# EAGLE schematic Resistor_Resistor (EAGLE 8.3.0), part 31 of 43 (continued)
## Nets (continued)
N$46: R7601.2 R7602.2 R7603.2 R7604.2 R7605.2 R7606.2 R7607.2 R7608.2 R7609.2 R7610.2 R7611.2 R7612.2 R7613.2 R7614.2 R7615.2 R7616.2 R7617.2 R7618.2 R7619.2 R7620.2 R7621.2 R7622.2 R7623.2 R7624.2 R7625.2 R7626.2 R7627.2 R7628.2 R7629.2 R7630.2 R7631.2 R7632.2 R7633.2 R7634.2 R7635.2 R7636.2 R7637.2 R7638.2 R7639.2 R7640.2 R7641.2 R7642.2 R7643.2 R7644.2 R7645.2 R7646.2 R7647.2 R7648.2 R7649.2 R7650.2 R7651.2 R7652.2 R7653.2 R7654.2 R7655.2 R7656.2 R7657.2 R7658.2 R7659.2 R7660.2 R7661.2 R7662.2 R7663.2 R7664.2 R7665.2 R7666.2 R7667.2 R7668.2 R7669.2 R7670.2 R7671.2 R7672.2 R7673.2 R7674.2 R7675.2 R7676.2 R7677.2 R7678.2 R7679.2 R7680.2 R7681.2 R7682.2 R7683.2 R7684.2 R7685.2 R7686.2 R7687.2 R7688.2 R7689.2 R7690.2 R7691.2 R7692.2 R7693.2 R7694.2 R7695.2 R7696.2 R7697.2 R7698.2 R7699.2 R7700.2 R7701.2 R7702.2 R7703.2 R7704.2 R7705.2 R7706.2 R7707.2 R7708.2 R7709.2 R7710.2 R7711.2 R7712.2 R7713.2 R7714.2 R7715.2 R7716.2 R7717.2 R7718.2 R7719.2 R7720.2 R7721.2 R7722.2 R7723.2 R7724.2 R7725.2 R7726.2 R7727.2 R7728.2 R7729.2 R7730.2 R7731.2 R7732.2 R7733.2 R7734.2 R7735.2 R7736.2 R7737.2 R7738.2 R7739.2 R7740.2 R7741.2 R7742.2 R7743.2 R7744.2 R7745.2 R7746.2 R7747.2 R7748.2 R7749.2 R7750.2 R7751.2 R7752.2 R7753.2 R7754.2 R7755.2 R7756.2 R7757.2 R7758.2 R7759.2 R7760.2 R7761.2 R7762.2 R7763.2 R7764.2 R7765.2 R7766.2 R7767.2 R7768.2 R7769.2 R7770.2 R7771.2 R7772.2 R7773.2 R7774.2 R7775.2 R7776.2 R7777.2 R7778.2 R7779.2 R7780.2 R7781.2 R7782.2 R7783.2 R7784.2 R7785.2 R7786.2 R7787.2 R7788.2 R7789.2 R7790.2 R7791.2 R7792.2 R7793.2 R7794.2 R7795.2 R7796.2 R7797.2 R7798.2 R7799.2 R7800.2 R7801.1 R7802.1 R7803.1 R7804.1 R7805.1 R7806.1 R7807.1 R7808.1 R7809.1 R7810.1 R7811.1 R7812.1 R7813.1 R7814.1 R7815.1 R7816.1 R7817.1 R7818.1 R7819.1 R7820.1 R7821.1 R7822.1 R7823.1 R7824.1 R7825.1 R7826.1 R7827.1 R7828.1 R7829.1 R7830.1 R7831.1 R7832.1 R7833.1 R7834.1 R7835.1 R7836.1 R7837.1 R7838.1 R7839.1 R7840.1 R7841.1 R7842.1 R7843.1 R7844.1 R7845.1 R7846.1 R7847.1 R7848.1 R7849.1 R7850.1 R7851.1 R7852.1 R7853.1 R7854.1 R7855.1 R7856.1 R7857.1 R7858.1 R7859.1 R7860.1 R7861.1 R7862.1 R7863.1 R7864.1 R7865.1 R7866.1 R7867.1 R7868.1 R7869.1 R7870.1 R7871.1 R7872.1 R7873.1 R7874.1 R7875.1 R7876.1 R7877.1 R7878.1 R7879.1 R7880.1 R7881.1 R7882.1 R7883.1 R7884.1 R7885.1 R7886.1 R7887.1 R7888.1 R7889.1 R7890.1 R7891.1 R7892.1 R7893.1 R7894.1 R7895.1 R7896.1 R7897.1 R7898.1 R7899.1 R7900.1 R7901.1 R7902.1 R7903.1 R7904.1 R7905.1 R7906.1 R7907.1 R7908.1 R7909.1 R7910.1 R7911.1 R7912.1 R7913.1 R7914.1 R7915.1 R7916.1 R7917.1 R7918.1 R7919.1 R7920.1 R7921.1 R7922.1 R7923.1 R7924.1 R7925.1 R7926.1 R7927.1 R7928.1 R7929.1 R7930.1 R7931.1 R7932.1 R7933.1 R7934.1 R7935.1 R7936.1 R7937.1 R7938.1 R7939.1 R7940.1 R7941.1 R7942.1 R7943.1 R7944.1 R7945.1 R7946.1 R7947.1 R7948.1 R7949.1 R7950.1 R7951.1 R7952.1 R7953.1 R7954.1 R7955.1 R7956.1 R7957.1 R7958.1 R7959.1 R7960.1 R7961.1 R7962.1 R7963.1 R7964.1 R7965.1 R7966.1 R7967.1 R7968.1 R7969.1 R7970.1 R7971.1 R7972.1 R7973.1 R7974.1 R7975.1 R7976.1 R7977.1 R7978.1 R7979.1 R7980.1 R7981.1 R7982.1 R7983.1 R7984.1 R7985.1 R7986.1 R7987.1 R7988.1 R7989.1 R7990.1 R7991.1 R7992.1 R7993.1 R7994.1 R7995.1 R7996.1 R7997.1 R7998.1 R7999.1 R8000.1
N$47: R7801.2 R7802.2 R7803.2 R7804.2 R7805.2 R7806.2 R7807.2 R7808.2 R7809.2 R7810.2 R7811.2 R7812.2 R7813.2 R7814.2 R7815.2 R7816.2 R7817.2 R7818.2 R7819.2 R7820.2 R7821.2 R7822.2 R7823.2 R7824.2 R7825.2 R7826.2 R7827.2 R7828.2 R7829.2 R7830.2 R7831.2 R7832.2 R7833.2 R7834.2 R7835.2 R7836.2 R7837.2 R7838.2 R7839.2 R7840.2 R7841.2 R7842.2 R7843.2 R7844.2 R7845.2 R7846.2 R7847.2 R7848.2 R7849.2 R7850.2 R7851.2 R7852.2 R7853.2 R7854.2 R7855.2 R7856.2 R7857.2 R7858.2 R7859.2 R7860.2 R7861.2 R7862.2 R7863.2 R7864.2 R7865.2 R7866.2 R7867.2 R7868.2 R7869.2 R7870.2 R7871.2 R7872.2 R7873.2 R7874.2 R7875.2 R7876.2 R7877.2 R7878.2 R7879.2 R7880.2 R7881.2 R7882.2 R7883.2 R7884.2 R7885.2 R7886.2 R7887.2 R7888.2 R7889.2 R7890.2 R7891.2 R7892.2 R7893.2 R7894.2 R7895.2 R7896.2 R7897.2 R7898.2 R7899.2 R7900.2 R7901.2 R7902.2 R7903.2 R7904.2 R7905.2 R7906.2 R7907.2 R7908.2 R7909.2 R7910.2 R7911.2 R7912.2 R7913.2 R7914.2 R7915.2 R7916.2 R7917.2 R7918.2 R7919.2 R7920.2 R7921.2 R7922.2 R7923.2 R7924.2 R7925.2 R7926.2 R7927.2 R7928.2 R7929.2 R7930.2 R7931.2 R7932.2 R7933.2 R7934.2 R7935.2 R7936.2 R7937.2 R7938.2 R7939.2 R7940.2 R7941.2 R7942.2 R7943.2 R7944.2 R7945.2 R7946.2 R7947.2 R7948.2 R7949.2 R7950.2 R7951.2 R7952.2 R7953.2 R7954.2 R7955.2 R7956.2 R7957.2 R7958.2 R7959.2 R7960.2 R7961.2 R7962.2 R7963.2 R7964.2 R7965.2 R7966.2 R7967.2 R7968.2 R7969.2 R7970.2 R7971.2 R7972.2 R7973.2 R7974.2 R7975.2 R7976.2 R7977.2 R7978.2 R7979.2 R7980.2 R7981.2 R7982.2 R7983.2 R7984.2 R7985.2 R7986.2 R7987.2 R7988.2 R7989.2 R7990.2 R7991.2 R7992.2 R7993.2 R7994.2 R7995.2 R7996.2 R7997.2 R7998.2 R7999.2 R8000.2 R8001.1 R8002.1 R8003.1 R8004.1 R8005.1 R8006.1 R8007.1 R8008.1 R8009.1 R8010.1 R8011.1 R8012.1 R8013.1 R8014.1 R8015.1 R8016.1 R8017.1 R8018.1 R8019.1 R8020.1 R8021.1 R8022.1 R8023.1 R8024.1 R8025.1 R8026.1 R8027.1 R8028.1 R8029.1 R8030.1 R8031.1 R8032.1 R8033.1 R8034.1 R8035.1 R8036.1 R8037.1 R8038.1 R8039.1 R8040.1 R8041.1 R8042.1 R8043.1 R8044.1 R8045.1 R8046.1 R8047.1 R8048.1 R8049.1 R8050.1 R8051.1 R8052.1 R8053.1 R8054.1 R8055.1 R8056.1 R8057.1 R8058.1 R8059.1 R8060.1 R8061.1 R8062.1 R8063.1 R8064.1 R8065.1 R8066.1 R8067.1 R8068.1 R8069.1 R8070.1 R8071.1 R8072.1 R8073.1 R8074.1 R8075.1 R8076.1 R8077.1 R8078.1 R8079.1 R8080.1 R8081.1 R8082.1 R8083.1 R8084.1 R8085.1 R8086.1 R8087.1 R8088.1 R8089.1 R8090.1 R8091.1 R8092.1 R8093.1 R8094.1 R8095.1 R8096.1 R8097.1 R8098.1 R8099.1 R8100.1 R8101.1 R8102.1 R8103.1 R8104.1 R8105.1 R8106.1 R8107.1 R8108.1 R8109.1 R8110.1 R8111.1 R8112.1 R8113.1 R8114.1 R8115.1 R8116.1 R8117.1 R8118.1 R8119.1 R8120.1 R8121.1 R8122.1 R8123.1 R8124.1 R8125.1 R8126.1 R8127.1 R8128.1 R8129.1 R8130.1 R8131.1 R8132.1 R8133.1 R8134.1 R8135.1 R8136.1 R8137.1 R8138.1 R8139.1 R8140.1 R8141.1 R8142.1 R8143.1 R8144.1 R8145.1 R8146.1 R8147.1 R8148.1 R8149.1 R8150.1 R8151.1 R8152.1 R8153.1 R8154.1 R8155.1 R8156.1 R8157.1 R8158.1 R8159.1 R8160.1 R8161.1 R8162.1 R8163.1 R8164.1 R8165.1 R8166.1 R8167.1 R8168.1 R8169.1 R8170.1 R8171.1 R8172.1 R8173.1 R8174.1 R8175.1 R8176.1 R8177.1 R8178.1 R8179.1 R8180.1 R8181.1 R8182.1 R8183.1 R8184.1 R8185.1 R8186.1 R8187.1 R8188.1 R8189.1 R8190.1 R8191.1 R8192.1 R8193.1 R8194.1 R8195.1 R8196.1 R8197.1 R8198.1 R8199.1 R8200.1
N$48: R8001.2 R8002.2 R8003.2 R8004.2 R8005.2 R8006.2 R8007.2 R8008.2 R8009.2 R8010.2 R8011.2 R8012.2 R8013.2 R8014.2 R8015.2 R8016.2 R8017.2 R8018.2 R8019.2 R8020.2 R8021.2 R8022.2 R8023.2 R8024.2 R8025.2 R8026.2 R8027.2 R8028.2 R8029.2 R8030.2 R8031.2 R8032.2 R8033.2 R8034.2 R8035.2 R8036.2 R8037.2 R8038.2 R8039.2 R8040.2 R8041.2 R8042.2 R8043.2 R8044.2 R8045.2 R8046.2 R8047.2 R8048.2 R8049.2 R8050.2 R8051.2 R8052.2 R8053.2 R8054.2 R8055.2 R8056.2 R8057.2 R8058.2 R8059.2 R8060.2 R8061.2 R8062.2 R8063.2 R8064.2 R8065.2 R8066.2 R8067.2 R8068.2 R8069.2 R8070.2 R8071.2 R8072.2 R8073.2 R8074.2 R8075.2 R8076.2 R8077.2 R8078.2 R8079.2 R8080.2 R8081.2 R8082.2 R8083.2 R8084.2 R8085.2 R8086.2 R8087.2 R8088.2 R8089.2 R8090.2 R8091.2 R8092.2 R8093.2 R8094.2 R8095.2 R8096.2 R8097.2 R8098.2 R8099.2 R8100.2 R8101.2 R8102.2 R8103.2 R8104.2 R8105.2 R8106.2 R8107.2 R8108.2 R8109.2 R8110.2 R8111.2 R8112.2 R8113.2 R8114.2 R8115.2 R8116.2 R8117.2 R8118.2 R8119.2 R8120.2 R8121.2 R8122.2 R8123.2 R8124.2 R8125.2 R8126.2 R8127.2 R8128.2 R8129.2 R8130.2 R8131.2 R8132.2 R8133.2 R8134.2 R8135.2 R8136.2 R8137.2 R8138.2 R8139.2 R8140.2 R8141.2 R8142.2 R8143.2 R8144.2 R8145.2 R8146.2 R8147.2 R8148.2 R8149.2 R8150.2 R8151.2 R8152.2 R8153.2 R8154.2 R8155.2 R8156.2 R8157.2 R8158.2 R8159.2 R8160.2 R8161.2 R8162.2 R8163.2 R8164.2 R8165.2 R8166.2 R8167.2 R8168.2 R8169.2 R8170.2 R8171.2 R8172.2 R8173.2 R8174.2 R8175.2 R8176.2 R8177.2 R8178.2 R8179.2 R8180.2 R8181.2 R8182.2 R8183.2 R8184.2 R8185.2 R8186.2 R8187.2 R8188.2 R8189.2 R8190.2 R8191.2 R8192.2 R8193.2 R8194.2 R8195.2 R8196.2 R8197.2 R8198.2 R8199.2 R8200.2 R8201.1 R8202.1 R8203.1 R8204.1 R8205.1 R8206.1 R8207.1 R8208.1 R8209.1 R8210.1 R8211.1 R8212.1 R8213.1 R8214.1 R8215.1 R8216.1 R8217.1 R8218.1 R8219.1 R8220.1 R8221.1 R8222.1 R8223.1 R8224.1 R8225.1 R8226.1 R8227.1 R8228.1 R8229.1 R8230.1 R8231.1 R8232.1 R8233.1 R8234.1 R8235.1 R8236.1 R8237.1 R8238.1 R8239.1 R8240.1 R8241.1 R8242.1 R8243.1 R8244.1 R8245.1 R8246.1 R8247.1 R8248.1 R8249.1 R8250.1 R8251.1 R8252.1 R8253.1 R8254.1 R8255.1 R8256.1 R8257.1 R8258.1 R8259.1 R8260.1 R8261.1 R8262.1 R8263.1 R8264.1 R8265.1 R8266.1 R8267.1 R8268.1 R8269.1 R8270.1 R8271.1 R8272.1 R8273.1 R8274.1 R8275.1 R8276.1 R8277.1 R8278.1 R8279.1 R8280.1 R8281.1 R8282.1 R8283.1 R8284.1 R8285.1 R8286.1 R8287.1 R8288.1 R8289.1 R8290.1 R8291.1 R8292.1 R8293.1 R8294.1 R8295.1 R8296.1 R8297.1 R8298.1 R8299.1 R8300.1 R8301.1 R8302.1 R8303.1 R8304.1 R8305.1 R8306.1 R8307.1 R8308.1 R8309.1 R8310.1 R8311.1 R8312.1 R8313.1 R8314.1 R8315.1 R8316.1 R8317.1 R8318.1 R8319.1 R8320.1 R8321.1 R8322.1 R8323.1 R8324.1 R8325.1 R8326.1 R8327.1 R8328.1 R8329.1 R8330.1 R8331.1 R8332.1 R8333.1 R8334.1 R8335.1 R8336.1 R8337.1 R8338.1 R8339.1 R8340.1 R8341.1 R8342.1 R8343.1 R8344.1 R8345.1 R8346.1 R8347.1 R8348.1 R8349.1 R8350.1 R8351.1 R8352.1 R8353.1 R8354.1 R8355.1 R8356.1 R8357.1 R8358.1 R8359.1 R8360.1 R8361.1 R8362.1 R8363.1 R8364.1 R8365.1 R8366.1 R8367.1 R8368.1 R8369.1 R8370.1 R8371.1 R8372.1 R8373.1 R8374.1 R8375.1 R8376.1 R8377.1 R8378.1 R8379.1 R8380.1 R8381.1 R8382.1 R8383.1 R8384.1 R8385.1 R8386.1 R8387.1 R8388.1 R8389.1 R8390.1 R8391.1 R8392.1 R8393.1 R8394.1 R8395.1 R8396.1 R8397.1 R8398.1 R8399.1 R8400.1
N$49: R8201.2 R8202.2 R8203.2 R8204.2 R8205.2 R8206.2 R8207.2 R8208.2 R8209.2 R8210.2 R8211.2 R8212.2 R8213.2 R8214.2 R8215.2 R8216.2 R8217.2 R8218.2 R8219.2 R8220.2 R8221.2 R8222.2 R8223.2 R8224.2 R8225.2 R8226.2 R8227.2 R8228.2 R8229.2 R8230.2 R8231.2 R8232.2 R8233.2 R8234.2 R8235.2 R8236.2 R8237.2 R8238.2 R8239.2 R8240.2 R8241.2 R8242.2 R8243.2 R8244.2 R8245.2 R8246.2 R8247.2 R8248.2 R8249.2 R8250.2 R8251.2 R8252.2 R8253.2 R8254.2 R8255.2 R8256.2 R8257.2 R8258.2 R8259.2 R8260.2 R8261.2 R8262.2 R8263.2 R8264.2 R8265.2 R8266.2 R8267.2 R8268.2 R8269.2 R8270.2 R8271.2 R8272.2 R8273.2 R8274.2 R8275.2 R8276.2 R8277.2 R8278.2 R8279.2 R8280.2 R8281.2 R8282.2 R8283.2 R8284.2 R8285.2 R8286.2 R8287.2 R8288.2 R8289.2 R8290.2 R8291.2 R8292.2 R8293.2 R8294.2 R8295.2 R8296.2 R8297.2 R8298.2 R8299.2 R8300.2 R8301.2 R8302.2 R8303.2 R8304.2 R8305.2 R8306.2 R8307.2 R8308.2 R8309.2 R8310.2 R8311.2 R8312.2 R8313.2 R8314.2 R8315.2 R8316.2 R8317.2 R8318.2 R8319.2 R8320.2 R8321.2 R8322.2 R8323.2 R8324.2 R8325.2 R8326.2 R8327.2 R8328.2 R8329.2 R8330.2 R8331.2 R8332.2 R8333.2 R8334.2 R8335.2 R8336.2 R8337.2 R8338.2 R8339.2 R8340.2 R8341.2 R8342.2 R8343.2 R8344.2 R8345.2 R8346.2 R8347.2 R8348.2 R8349.2 R8350.2 R8351.2 R8352.2 R8353.2 R8354.2 R8355.2 R8356.2 R8357.2 R8358.2 R8359.2 R8360.2 R8361.2 R8362.2 R8363.2 R8364.2 R8365.2 R8366.2 R8367.2 R8368.2 R8369.2 R8370.2 R8371.2 R8372.2 R8373.2 R8374.2 R8375.2 R8376.2 R8377.2 R8378.2 R8379.2 R8380.2 R8381.2 R8382.2 R8383.2 R8384.2 R8385.2 R8386.2 R8387.2 R8388.2 R8389.2 R8390.2 R8391.2 R8392.2 R8393.2 R8394.2 R8395.2 R8396.2 R8397.2 R8398.2 R8399.2 R8400.2 R8401.1 R8402.1 R8403.1 R8404.1 R8405.1 R8406.1 R8407.1 R8408.1 R8409.1 R8410.1 R8411.1 R8412.1 R8413.1 R8414.1 R8415.1 R8416.1 R8417.1 R8418.1 R8419.1 R8420.1 R8421.1 R8422.1 R8423.1 R8424.1 R8425.1 R8426.1 R8427.1 R8428.1 R8429.1 R8430.1 R8431.1 R8432.1 R8433.1 R8434.1 R8435.1 R8436.1 R8437.1 R8438.1 R8439.1 R8440.1 R8441.1 R8442.1 R8443.1 R8444.1 R8445.1 R8446.1 R8447.1 R8448.1 R8449.1 R8450.1 R8451.1 R8452.1 R8453.1 R8454.1 R8455.1 R8456.1 R8457.1 R8458.1 R8459.1 R8460.1 R8461.1 R8462.1 R8463.1 R8464.1 R8465.1 R8466.1 R8467.1 R8468.1 R8469.1 R8470.1 R8471.1 R8472.1 R8473.1 R8474.1 R8475.1 R8476.1 R8477.1 R8478.1 R8479.1 R8480.1 R8481.1 R8482.1 R8483.1 R8484.1 R8485.1 R8486.1 R8487.1 R8488.1 R8489.1 R8490.1 R8491.1 R8492.1 R8493.1 R8494.1 R8495.1 R8496.1 R8497.1 R8498.1 R8499.1 R8500.1 R8501.1 R8502.1 R8503.1 R8504.1 R8505.1 R8506.1 R8507.1 R8508.1 R8509.1 R8510.1 R8511.1 R8512.1 R8513.1 R8514.1 R8515.1 R8516.1 R8517.1 R8518.1 R8519.1 R8520.1 R8521.1 R8522.1 R8523.1 R8524.1 R8525.1 R8526.1 R8527.1 R8528.1 R8529.1 R8530.1 R8531.1 R8532.1 R8533.1 R8534.1 R8535.1 R8536.1 R8537.1 R8538.1 R8539.1 R8540.1 R8541.1 R8542.1 R8543.1 R8544.1 R8545.1 R8546.1 R8547.1 R8548.1 R8549.1 R8550.1 R8551.1 R8552.1 R8553.1 R8554.1 R8555.1 R8556.1 R8557.1 R8558.1 R8559.1 R8560.1 R8561.1 R8562.1 R8563.1 R8564.1 R8565.1 R8566.1 R8567.1 R8568.1 R8569.1 R8570.1 R8571.1 R8572.1 R8573.1 R8574.1 R8575.1 R8576.1 R8577.1 R8578.1 R8579.1 R8580.1 R8581.1 R8582.1 R8583.1 R8584.1 R8585.1 R8586.1 R8587.1 R8588.1 R8589.1 R8590.1 R8591.1 R8592.1 R8593.1 R8594.1 R8595.1 R8596.1 R8597.1 R8598.1 R8599.1 R8600.1
N$50: R8401.2 R8402.2 R8403.2 R8404.2 R8405.2 R8406.2 R8407.2 R8408.2 R8409.2 R8410.2 R8411.2 R8412.2 R8413.2 R8414.2 R8415.2 R8416.2 R8417.2 R8418.2 R8419.2 R8420.2 R8421.2 R8422.2 R8423.2 R8424.2 R8425.2 R8426.2 R8427.2 R8428.2 R8429.2 R8430.2 R8431.2 R8432.2 R8433.2 R8434.2 R8435.2 R8436.2 R8437.2 R8438.2 R8439.2 R8440.2 R8441.2 R8442.2 R8443.2 R8444.2 R8445.2 R8446.2 R8447.2 R8448.2 R8449.2 R8450.2 R8451.2 R8452.2 R8453.2 R8454.2 R8455.2 R8456.2 R8457.2 R8458.2 R8459.2 R8460.2 R8461.2 R8462.2 R8463.2 R8464.2 R8465.2 R8466.2 R8467.2 R8468.2 R8469.2 R8470.2 R8471.2 R8472.2 R8473.2 R8474.2 R8475.2 R8476.2 R8477.2 R8478.2 R8479.2 R8480.2 R8481.2 R8482.2 R8483.2 R8484.2 R8485.2 R8486.2 R8487.2 R8488.2 R8489.2 R8490.2 R8491.2 R8492.2 R8493.2 R8494.2 R8495.2 R8496.2 R8497.2 R8498.2 R8499.2 R8500.2 R8501.2 R8502.2 R8503.2 R8504.2 R8505.2 R8506.2 R8507.2 R8508.2 R8509.2 R8510.2 R8511.2 R8512.2 R8513.2 R8514.2 R8515.2 R8516.2 R8517.2 R8518.2 R8519.2 R8520.2 R8521.2 R8522.2 R8523.2 R8524.2 R8525.2 R8526.2 R8527.2 R8528.2 R8529.2 R8530.2 R8531.2 R8532.2 R8533.2 R8534.2 R8535.2 R8536.2 R8537.2 R8538.2 R8539.2 R8540.2 R8541.2 R8542.2 R8543.2 R8544.2 R8545.2 R8546.2 R8547.2 R8548.2 R8549.2 R8550.2 R8551.2 R8552.2 R8553.2 R8554.2 R8555.2 R8556.2 R8557.2 R8558.2 R8559.2 R8560.2 R8561.2 R8562.2 R8563.2 R8564.2 R8565.2 R8566.2 R8567.2 R8568.2 R8569.2 R8570.2 R8571.2 R8572.2 R8573.2 R8574.2 R8575.2 R8576.2 R8577.2 R8578.2 R8579.2 R8580.2 R8581.2 R8582.2 R8583.2 R8584.2 R8585.2 R8586.2 R8587.2 R8588.2 R8589.2 R8590.2 R8591.2 R8592.2 R8593.2 R8594.2 R8595.2 R8596.2 R8597.2 R8598.2 R8599.2 R8600.2 R8601.1 R8602.1 R8603.1 R8604.1 R8605.1 R8606.1 R8607.1 R8608.1 R8609.1 R8610.1 R8611.1 R8612.1 R8613.1 R8614.1 R8615.1 R8616.1 R8617.1 R8618.1 R8619.1 R8620.1 R8621.1 R8622.1 R8623.1 R8624.1 R8625.1 R8626.1 R8627.1 R8628.1 R8629.1 R8630.1 R8631.1 R8632.1 R8633.1 R8634.1 R8635.1 R8636.1 R8637.1 R8638.1 R8639.1 R8640.1 R8641.1 R8642.1 R8643.1 R8644.1 R8645.1 R8646.1 R8647.1 R8648.1 R8649.1 R8650.1 R8651.1 R8652.1 R8653.1 R8654.1 R8655.1 R8656.1 R8657.1 R8658.1 R8659.1 R8660.1 R8661.1 R8662.1 R8663.1 R8664.1 R8665.1 R8666.1 R8667.1 R8668.1 R8669.1 R8670.1 R8671.1 R8672.1 R8673.1 R8674.1 R8675.1 R8676.1 R8677.1 R8678.1 R8679.1 R8680.1 R8681.1 R8682.1 R8683.1 R8684.1 R8685.1 R8686.1 R8687.1 R8688.1 R8689.1 R8690.1 R8691.1 R8692.1 R8693.1 R8694.1 R8695.1 R8696.1 R8697.1 R8698.1 R8699.1 R8700.1 R8701.1 R8702.1 R8703.1 R8704.1 R8705.1 R8706.1 R8707.1 R8708.1 R8709.1 R8710.1 R8711.1 R8712.1 R8713.1 R8714.1 R8715.1 R8716.1 R8717.1 R8718.1 R8719.1 R8720.1 R8721.1 R8722.1 R8723.1 R8724.1 R8725.1 R8726.1 R8727.1 R8728.1 R8729.1 R8730.1 R8731.1 R8732.1 R8733.1 R8734.1 R8735.1 R8736.1 R8737.1 R8738.1 R8739.1 R8740.1 R8741.1 R8742.1 R8743.1 R8744.1 R8745.1 R8746.1 R8747.1 R8748.1 R8749.1 R8750.1 R8751.1 R8752.1 R8753.1 R8754.1 R8755.1 R8756.1 R8757.1 R8758.1 R8759.1 R8760.1 R8761.1 R8762.1 R8763.1 R8764.1 R8765.1 R8766.1 R8767.1 R8768.1 R8769.1 R8770.1 R8771.1 R8772.1 R8773.1 R8774.1 R8775.1 R8776.1 R8777.1 R8778.1 R8779.1 R8780.1 R8781.1 R8782.1 R8783.1 R8784.1 R8785.1 R8786.1 R8787.1 R8788.1 R8789.1 R8790.1 R8791.1 R8792.1 R8793.1 R8794.1 R8795.1 R8796.1 R8797.1 R8798.1 R8799.1 R8800.1
N$51: R8601.2 R8602.2 R8603.2 R8604.2 R8605.2 R8606.2 R8607.2 R8608.2 R8609.2 R8610.2 R8611.2 R8612.2 R8613.2 R8614.2 R8615.2 R8616.2 R8617.2 R8618.2 R8619.2 R8620.2 R8621.2 R8622.2 R8623.2 R8624.2 R8625.2 R8626.2 R8627.2 R8628.2 R8629.2 R8630.2 R8631.2 R8632.2 R8633.2 R8634.2 R8635.2 R8636.2 R8637.2 R8638.2 R8639.2 R8640.2 R8641.2 R8642.2 R8643.2 R8644.2 R8645.2 R8646.2 R8647.2 R8648.2 R8649.2 R8650.2 R8651.2 R8652.2 R8653.2 R8654.2 R8655.2 R8656.2 R8657.2 R8658.2 R8659.2 R8660.2 R8661.2 R8662.2 R8663.2 R8664.2 R8665.2 R8666.2 R8667.2 R8668.2 R8669.2 R8670.2 R8671.2 R8672.2 R8673.2 R8674.2 R8675.2 R8676.2 R8677.2 R8678.2 R8679.2 R8680.2 R8681.2 R8682.2 R8683.2 R8684.2 R8685.2 R8686.2 R8687.2 R8688.2 R8689.2 R8690.2 R8691.2 R8692.2 R8693.2 R8694.2 R8695.2 R8696.2 R8697.2 R8698.2 R8699.2 R8700.2 R8701.2 R8702.2 R8703.2 R8704.2 R8705.2 R8706.2 R8707.2 R8708.2 R8709.2 R8710.2 R8711.2 R8712.2 R8713.2 R8714.2 R8715.2 R8716.2 R8717.2 R8718.2 R8719.2 R8720.2 R8721.2 R8722.2 R8723.2 R8724.2 R8725.2 R8726.2 R8727.2 R8728.2 R8729.2 R8730.2 R8731.2 R8732.2 R8733.2 R8734.2 R8735.2 R8736.2 R8737.2 R8738.2 R8739.2 R8740.2 R8741.2 R8742.2 R8743.2 R8744.2 R8745.2 R8746.2 R8747.2 R8748.2 R8749.2 R8750.2 R8751.2 R8752.2 R8753.2 R8754.2 R8755.2 R8756.2 R8757.2 R8758.2 R8759.2 R8760.2 R8761.2 R8762.2 R8763.2 R8764.2 R8765.2 R8766.2 R8767.2 R8768.2 R8769.2 R8770.2 R8771.2 R8772.2 R8773.2 R8774.2 R8775.2 R8776.2 R8777.2 R8778.2 R8779.2 R8780.2 R8781.2 R8782.2 R8783.2 R8784.2 R8785.2 R8786.2 R8787.2 R8788.2 R8789.2 R8790.2 R8791.2 R8792.2 R8793.2 R8794.2 R8795.2 R8796.2 R8797.2 R8798.2 R8799.2 R8800.2 R8801.1 R8802.1 R8803.1 R8804.1 R8805.1 R8806.1 R8807.1 R8808.1 R8809.1 R8810.1 R8811.1 R8812.1 R8813.1 R8814.1 R8815.1 R8816.1 R8817.1 R8818.1 R8819.1 R8820.1 R8821.1 R8822.1 R8823.1 R8824.1 R8825.1 R8826.1 R8827.1 R8828.1 R8829.1 R8830.1 R8831.1 R8832.1 R8833.1 R8834.1 R8835.1 R8836.1 R8837.1 R8838.1 R8839.1 R8840.1 R8841.1 R8842.1 R8843.1 R8844.1 R8845.1 R8846.1 R8847.1 R8848.1 R8849.1 R8850.1 R8851.1 R8852.1 R8853.1 R8854.1 R8855.1 R8856.1 R8857.1 R8858.1 R8859.1 R8860.1 R8861.1 R8862.1 R8863.1 R8864.1 R8865.1 R8866.1 R8867.1 R8868.1 R8869.1 R8870.1 R8871.1 R8872.1 R8873.1 R8874.1 R8875.1 R8876.1 R8877.1 R8878.1 R8879.1 R8880.1 R8881.1 R8882.1 R8883.1 R8884.1 R8885.1 R8886.1 R8887.1 R8888.1 R8889.1 R8890.1 R8891.1 R8892.1 R8893.1 R8894.1 R8895.1 R8896.1 R8897.1 R8898.1 R8899.1 R8900.1 R8901.1 R8902.1 R8903.1 R8904.1 R8905.1 R8906.1 R8907.1 R8908.1 R8909.1 R8910.1 R8911.1 R8912.1 R8913.1 R8914.1 R8915.1 R8916.1 R8917.1 R8918.1 R8919.1 R8920.1 R8921.1 R8922.1 R8923.1 R8924.1 R8925.1 R8926.1 R8927.1 R8928.1 R8929.1 R8930.1 R8931.1 R8932.1 R8933.1 R8934.1 R8935.1 R8936.1 R8937.1 R8938.1 R8939.1 R8940.1 R8941.1 R8942.1 R8943.1 R8944.1 R8945.1 R8946.1 R8947.1 R8948.1 R8949.1 R8950.1 R8951.1 R8952.1 R8953.1 R8954.1 R8955.1 R8956.1 R8957.1 R8958.1 R8959.1 R8960.1 R8961.1 R8962.1 R8963.1 R8964.1 R8965.1 R8966.1 R8967.1 R8968.1 R8969.1 R8970.1 R8971.1 R8972.1 R8973.1 R8974.1 R8975.1 R8976.1 R8977.1 R8978.1 R8979.1 R8980.1 R8981.1 R8982.1 R8983.1 R8984.1 R8985.1 R8986.1 R8987.1 R8988.1 R8989.1 R8990.1 R8991.1 R8992.1 R8993.1 R8994.1 R8995.1 R8996.1 R8997.1 R8998.1 R8999.1 R9000.1
N$52: R8801.2 R8802.2 R8803.2 R8804.2 R8805.2 R8806.2 R8807.2 R8808.2 R8809.2 R8810.2 R8811.2 R8812.2 R8813.2 R8814.2 R8815.2 R8816.2 R8817.2 R8818.2 R8819.2 R8820.2 R8821.2 R8822.2 R8823.2 R8824.2 R8825.2 R8826.2 R8827.2 R8828.2 R8829.2 R8830.2 R8831.2 R8832.2 R8833.2 R8834.2 R8835.2 R8836.2 R8837.2 R8838.2 R8839.2 R8840.2 R8841.2 R8842.2 R8843.2 R8844.2 R8845.2 R8846.2 R8847.2 R8848.2 R8849.2 R8850.2 R8851.2 R8852.2 R8853.2 R8854.2 R8855.2 R8856.2 R8857.2 R8858.2 R8859.2 R8860.2 R8861.2 R8862.2 R8863.2 R8864.2 R8865.2 R8866.2 R8867.2 R8868.2 R8869.2 R8870.2 R8871.2 R8872.2 R8873.2 R8874.2 R8875.2 R8876.2 R8877.2 R8878.2 R8879.2 R8880.2 R8881.2 R8882.2 R8883.2 R8884.2 R8885.2 R8886.2 R8887.2 R8888.2 R8889.2 R8890.2 R8891.2 R8892.2 R8893.2 R8894.2 R8895.2 R8896.2 R8897.2 R8898.2 R8899.2 R8900.2 R8901.2 R8902.2 R8903.2 R8904.2 R8905.2 R8906.2 R8907.2 R8908.2 R8909.2 R8910.2 R8911.2 R8912.2 R8913.2 R8914.2 R8915.2 R8916.2 R8917.2 R8918.2 R8919.2 R8920.2 R8921.2 R8922.2 R8923.2 R8924.2 R8925.2 R8926.2 R8927.2 R8928.2 R8929.2 R8930.2 R8931.2 R8932.2 R8933.2 R8934.2 R8935.2 R8936.2 R8937.2 R8938.2 R8939.2 R8940.2 R8941.2 R8942.2 R8943.2 R8944.2 R8945.2 R8946.2 R8947.2 R8948.2 R8949.2 R8950.2 R8951.2 R8952.2 R8953.2 R8954.2 R8955.2 R8956.2 R8957.2 R8958.2 R8959.2 R8960.2 R8961.2 R8962.2 R8963.2 R8964.2 R8965.2 R8966.2 R8967.2 R8968.2 R8969.2 R8970.2 R8971.2 R8972.2 R8973.2 R8974.2 R8975.2 R8976.2 R8977.2 R8978.2 R8979.2 R8980.2 R8981.2 R8982.2 R8983.2 R8984.2 R8985.2 R8986.2 R8987.2 R8988.2 R8989.2 R8990.2 R8991.2 R8992.2 R8993.2 R8994.2 R8995.2 R8996.2 R8997.2 R8998.2 R8999.2 R9000.2 R9001.1 R9002.1 R9003.1 R9004.1 R9005.1 R9006.1 R9007.1 R9008.1 R9009.1 R9010.1 R9011.1 R9012.1 R9013.1 R9014.1 R9015.1 R9016.1 R9017.1 R9018.1 R9019.1 R9020.1 R9021.1 R9022.1 R9023.1 R9024.1 R9025.1 R9026.1 R9027.1 R9028.1 R9029.1 R9030.1 R9031.1 R9032.1 R9033.1 R9034.1 R9035.1 R9036.1 R9037.1 R9038.1 R9039.1 R9040.1 R9041.1 R9042.1 R9043.1 R9044.1 R9045.1 R9046.1 R9047.1 R9048.1 R9049.1 R9050.1 R9051.1 R9052.1 R9053.1 R9054.1 R9055.1 R9056.1 R9057.1 R9058.1 R9059.1 R9060.1 R9061.1 R9062.1 R9063.1 R9064.1 R9065.1 R9066.1 R9067.1 R9068.1 R9069.1 R9070.1 R9071.1 R9072.1 R9073.1 R9074.1 R9075.1 R9076.1 R9077.1 R9078.1 R9079.1 R9080.1 R9081.1 R9082.1 R9083.1 R9084.1 R9085.1 R9086.1 R9087.1 R9088.1 R9089.1 R9090.1 R9091.1 R9092.1 R9093.1 R9094.1 R9095.1 R9096.1 R9097.1 R9098.1 R9099.1 R9100.1 R9101.1 R9102.1 R9103.1 R9104.1 R9105.1 R9106.1 R9107.1 R9108.1 R9109.1 R9110.1 R9111.1 R9112.1 R9113.1 R9114.1 R9115.1 R9116.1 R9117.1 R9118.1 R9119.1 R9120.1 R9121.1 R9122.1 R9123.1 R9124.1 R9125.1 R9126.1 R9127.1 R9128.1 R9129.1 R9130.1 R9131.1 R9132.1 R9133.1 R9134.1 R9135.1 R9136.1 R9137.1 R9138.1 R9139.1 R9140.1 R9141.1 R9142.1 R9143.1 R9144.1 R9145.1 R9146.1 R9147.1 R9148.1 R9149.1 R9150.1 R9151.1 R9152.1 R9153.1 R9154.1 R9155.1 R9156.1 R9157.1 R9158.1 R9159.1 R9160.1 R9161.1 R9162.1 R9163.1 R9164.1 R9165.1 R9166.1 R9167.1 R9168.1 R9169.1 R9170.1 R9171.1 R9172.1 R9173.1 R9174.1 R9175.1 R9176.1 R9177.1 R9178.1 R9179.1 R9180.1 R9181.1 R9182.1 R9183.1 R9184.1 R9185.1 R9186.1 R9187.1 R9188.1 R9189.1 R9190.1 R9191.1 R9192.1 R9193.1 R9194.1 R9195.1 R9196.1 R9197.1 R9198.1 R9199.1 R9200.1